# EasyEDA Pro project Arduino UNO DIY.eprj, schematic Schematic4
Board Name: Power Shield; Create Date: 2025-09-24; Page Name: P1; Project Name: Arduino UNO DIY; Schematic Name: Schematic3_2; Update Date: 2025-09-24; Company: m039; Drawn: Dmitry Mozgin; Page Size: A4; Version: V1.0
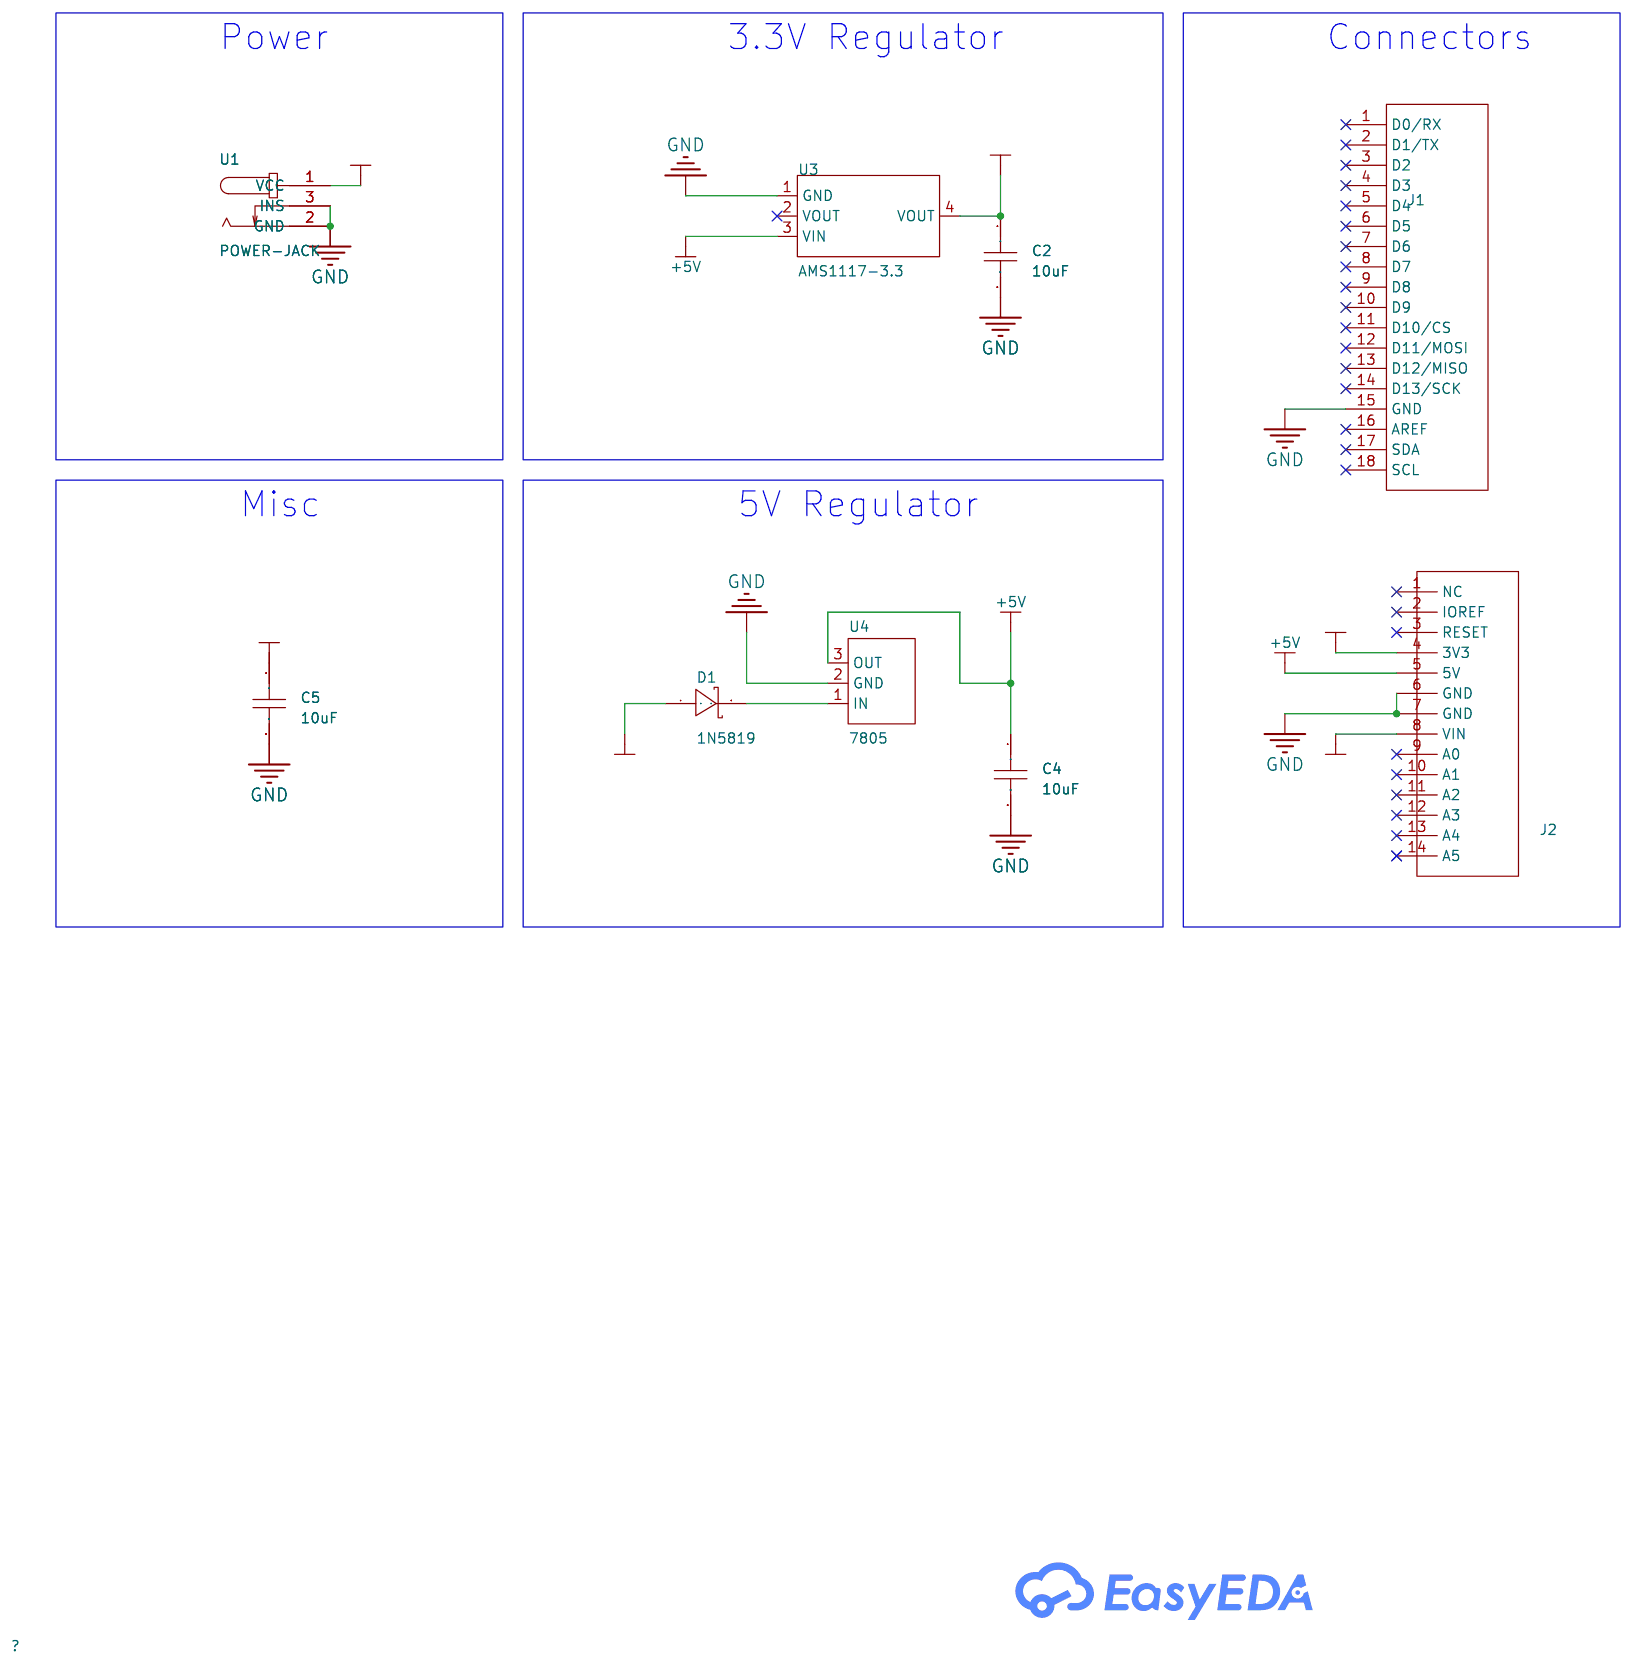
[diagram p4: schematic sheet]

## Parts
C2  10uF  [CAP-TH_L4.8-W2.4-P5.08-D0.6]
C4  10uF  [CAP-TH_L4.8-W2.4-P5.08-D0.6]
C5  10uF  [CAP-TH_L4.8-W2.4-P5.08-D0.6]
D1  1N5819  [DO-41_BD2.4-L4.7-P8.70-D0.9-FD]
J1  -  [Arduino Uno Top Header]
J2  -  [Arduino Uno Bottom Header]
U1  POWER-JACK  [DC-IN-TH_POWER-JACK]
U3  AMS1117-3.3  [SOT-223-3_L6.5-W3.4-P2.30-LS7.0-BR]
U4  7805  [TO-220-3_L10.2-W4.5-P2.54-L]

## Library data of the parts
C2 C4 C5 = CC1H221KC1EDB44B1100: LCSC Part Name: 220pF ±10% 50V; Supplier Part: C2832511; Manufacturer: Dersonic(德尔创); Supplier Footprint: 插件,P=5.08mm; JLCPCB Part Class: Extended Part; Datasheet: https://atta.szlcsc.com/upload/public/pdf/source/20211103/ADF2DBCED823A6AEFAA1F6C91B9CD8F4.pdf; Supplier: LCSC; Tolerance: ±10%; Voltage Rating: 50V; Pin Spacing: 5.08mm; Temperature Coefficient: Y5P; Diameter: 4.8mm; Body Thickness: 2.4mm
D1 = 1N5819_C2474: LCSC Part Name: 电压:40V 电流:1A; Supplier Part: C2474; Manufacturer: MDD(辰达半导体); Supplier Footprint: DO-41; JLCPCB Part Class: Extended Part; Datasheet: https://item.szlcsc.com/datasheet/1N5819/2851.html; Supplier: LCSC; Voltage - Forward(Vf@If): 600mV@1A; Voltage - DC Reverse(Vr): 40V; Current - Rectified: 1A; Reverse Leakage Current (Ir): 500uA@40V; Operating Junction Temperature Range: -65℃~+150℃; Non-Repetitive Peak Forward Surge Current: 25A
J1 = Arduino Uno Top Header
J2 = Arduino Uno Header Bottom
U1 = POWER-JACK: Supplier Part: C9900001795; JLCPCB Part Class: Extended Part; Supplier: LCSC
U3 = AMS1117-3.3_C6186: LCSC Part Name: 输出3.3V 1A; Supplier Part: C6186; Manufacturer: AMS; Supplier Footprint: SOT-223; JLCPCB Part Class: Basic Part; Datasheet: https://item.szlcsc.com/datasheet/AMS1117-3.3/6652.html; Supplier: LCSC; Output Type: Fixed; Voltage - Supply: 16V; Output Voltage: 3.3V; Output Current: 1A; Power Supply Rejection Ratio (PSRR): 72dB@(120Hz); Voltage Dropout: 1.1V@(800mA); standby current: 5mA; Features: Over Current Protection；Over Temperature Protection; Operating Temperature: -40℃~+125℃; Output Configuration: Positive; Number of Outputs: 1
U4 = 7805: Supplier Part: C2941265; Supplier Footprint: TO-220; JLCPCB Part Class: Extended Part; Supplier: LCSC

## Nets
+3.3V: C2.1 J2.4(3V3) U3.4(VOUT)
+5V: C4.1 J2.5(5V) U3.3(VIN) U4.3(OUT)
GND: C2.2 C4.2 C5.2 J1.15(GND) J2.6(GND) J2.7(GND) U1.2(GND) U1.3(INS) U3.1(GND) U4.2(GND)
VIN: C5.1 D1.1(A) J2.8(VIN) U1.1(VCC)
$1N4261: D1.2(K) U4.1(IN)

Not connected (* = marked no-connect by the designer): J1 1(D0/RX)* 2(D1/TX)* 3(D2)* 4(D3)* 5(D4)* 6(D5)* 7(D6)* 8(D7)* 9(D8)* 10(D9)* 11(D10/CS)* 12(D11/MOSI)* 13(D12/MISO)* 14(D13/SCK)* 16(AREF)* 17(SDA)* 18(SCL)*; J2 1(NC)* 2(IOREF)* 3(RESET)* 9(A0)* 10(A1)* 11(A2)* 12(A3)* 13(A4)* 14(A5)*; U3 2(VOUT)*

## Notes on the sheet
- Power
- 3.3V Regulator
- Connectors
- Misc
- 5V Regulator
